# EasyEDA Pro project STM32G303的双FOC电机驱动.eprj, board axdr_v1.2
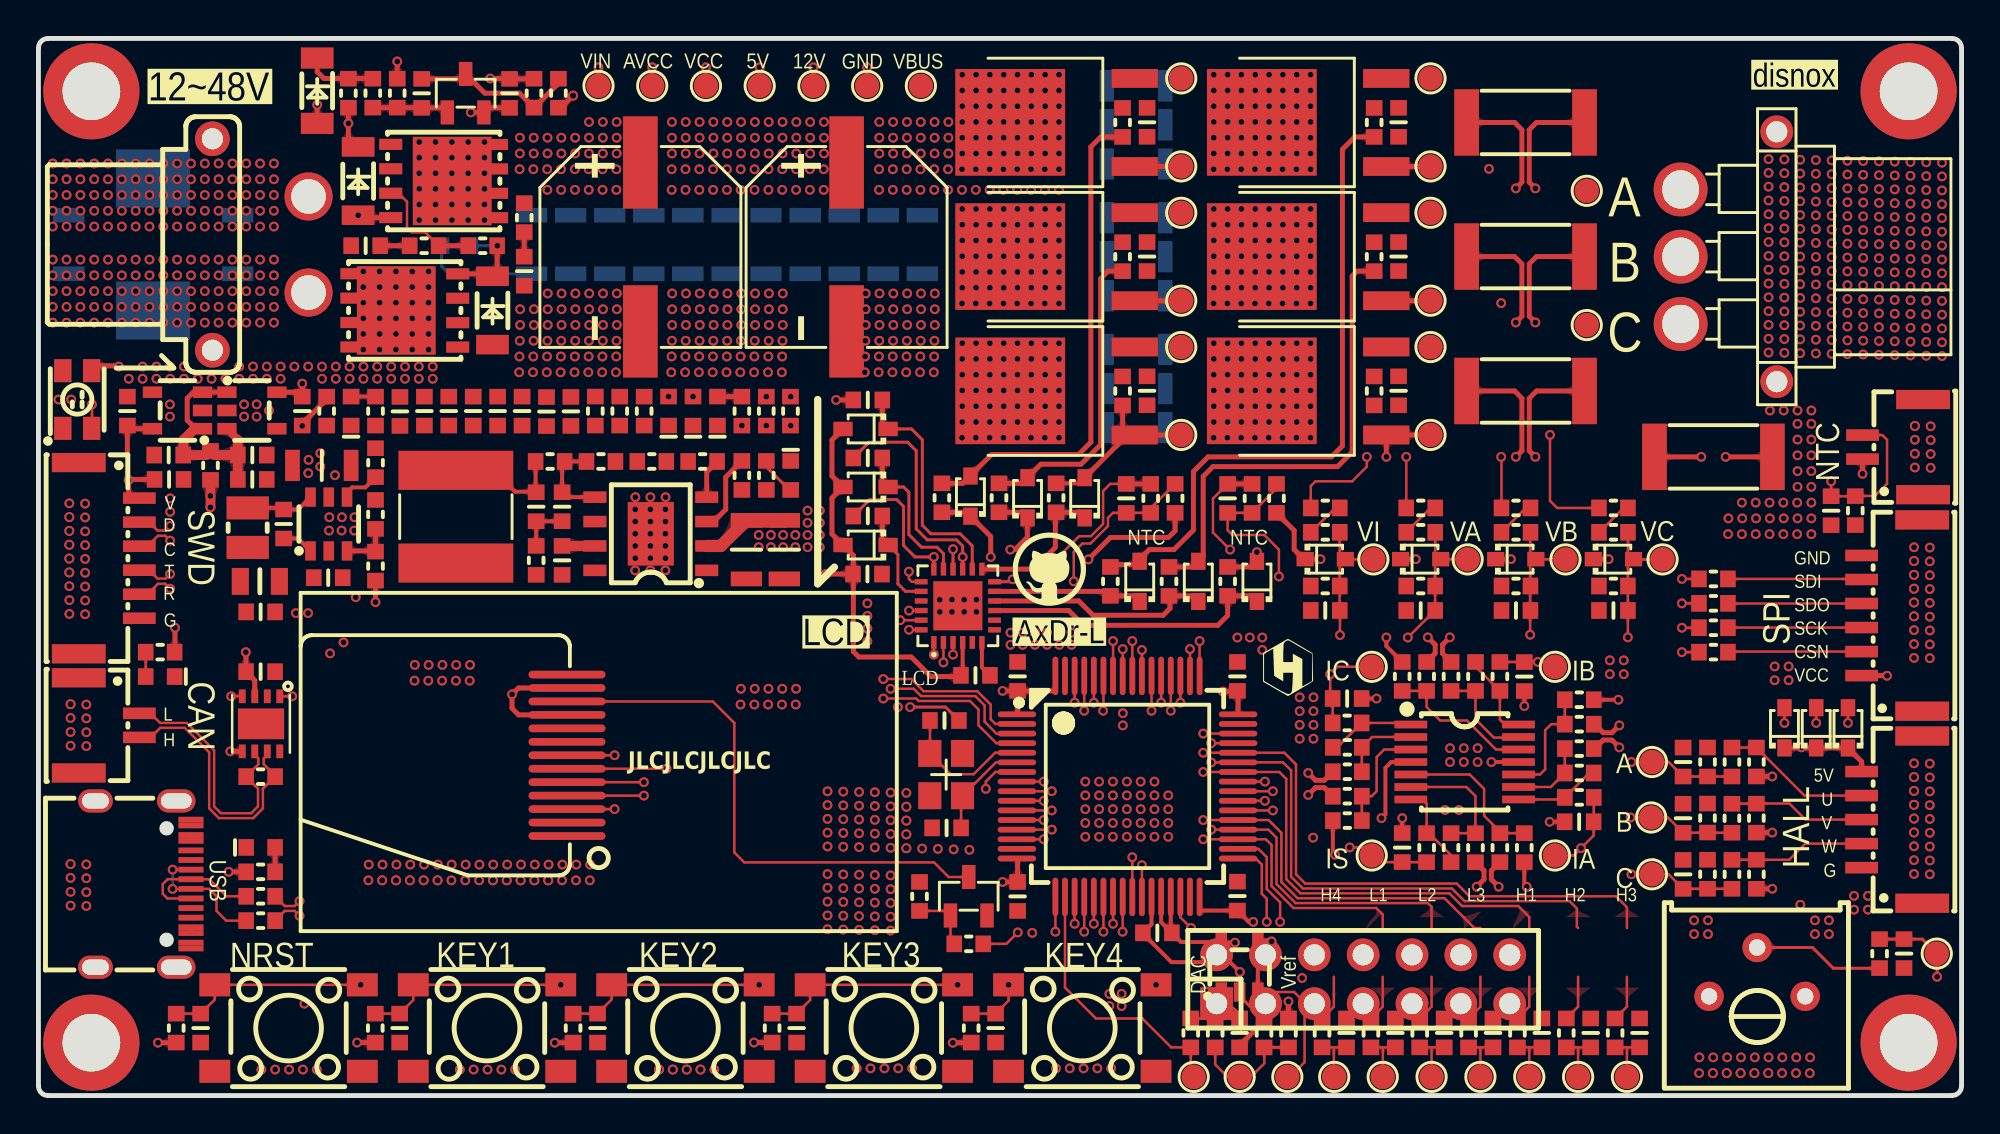
[diagram p5: board, top side]
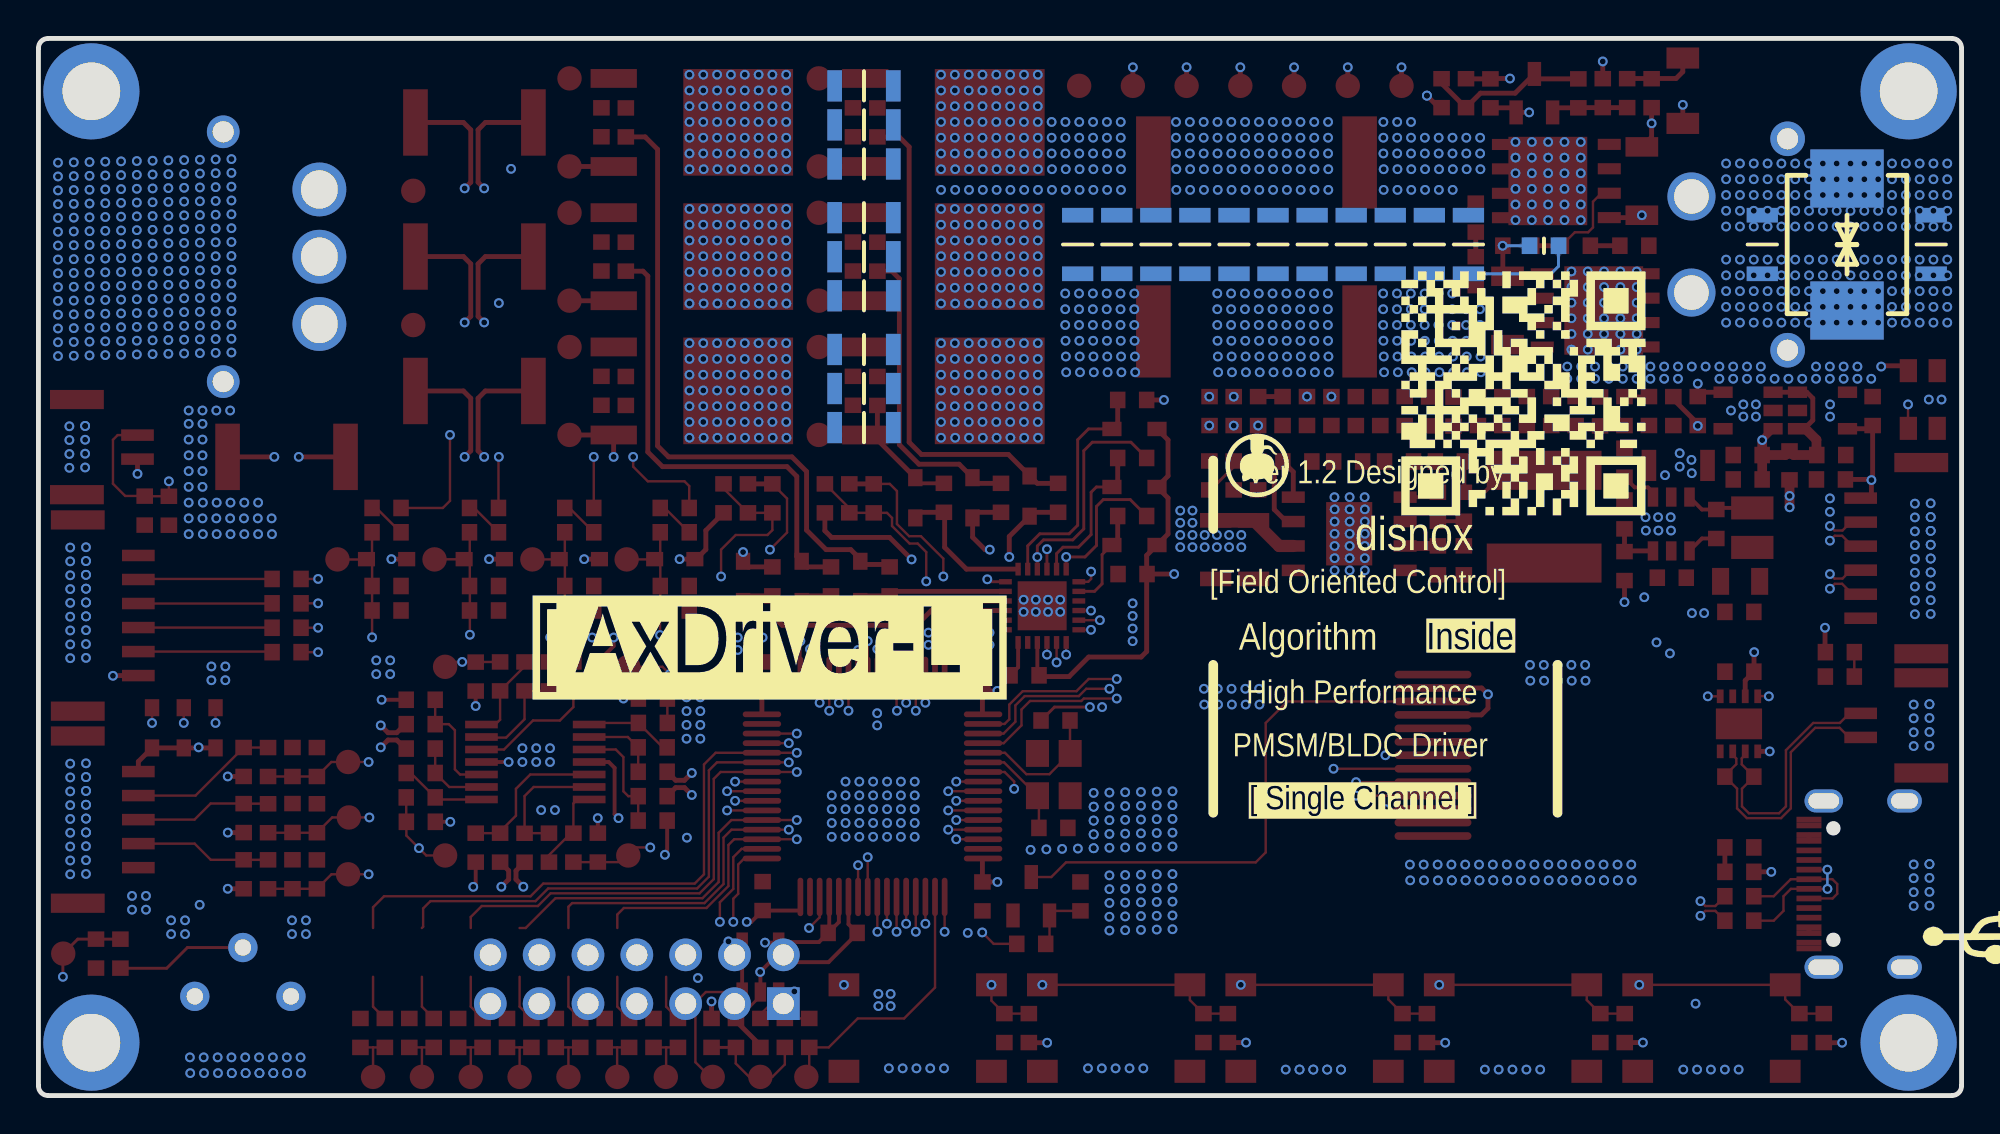
[diagram p6: board, bottom side, seen from below]

Outline 100 x 55 mm; copper layers: Top Layer, Inner1, Inner2, 内层3, 内层4, Bottom Layer. Coordinates in mm from the lower left corner of the outline.
Outline path: 0,54.5 arc(0.15,54.85) 0.5,55 99.5,55 arc(99.85,54.85) 100,54.5 100,0.5 arc(99.85,0.15) 99.5,0 0.5,0 arc(0.15,0.15) 0,0.5 0,54.5
Stack: Top Layer 0.035mm 外层铜厚1oz / Dielectric1 0.0994mm 3313 RC57% 4.2mil / Inner1 0.0152mm 内层铜厚 / Dielectric2 0.55mm 0.55mm H/H不含铜 / Inner2 0.0152mm 内层铜厚 / Dielectric3 0.1088mm 2116 RC54% 4.9mil / 内层3 0.0152mm 内层铜厚 / Dielectric4 0.55mm 0.55mm H/H不含铜 / 内层4 0.0152mm 内层铜厚 / Dielectric5 0.0994mm 3313 RC57% 4.2mil / Bottom Layer 0.035mm 外层铜厚1oz

## Design rules (mm)
template: 用户自定义配置
spacing safeClearance (default): track to track 0.127, other pairs 0.127 to 0.127
track width trackWidth (default): min 0.127, default 0.254, max 2.54
differential pair differentialPair (default): width min 0.127, default 0.254, max 2.54; gap min 0.127, default 0.127
via viaSize (default): diameter min 0.5, default 0.508, max 10; hole min 0.3, default 0.305, max 5.999

## Placement (name value [footprint] x y rotation side)
C1  100nF  [C0603_S]  24.5 52.15 90 top
C2  100nF  [C0603_S]  19.93 52.15 90 top
C3  220uF  [CAP-SMD_BD10.0-L10.3-W10.3-LS11.0-R-RD]  42.02 44.15 90 top
C4  220uF  [CAP-SMD_BD10.0-L10.3-W10.3-LS11.0-R-RD]  31.3 44.15 90 top
C5  10uF  [C1206_S]  37.83 44.41 270 bottom
C6  10uF  [C1206_S]  39.87 44.41 270 bottom
C7  10uF  [C1206_S]  45.96 44.41 270 bottom
C8  10uF  [C1206_S]  35.8 44.41 270 bottom
C9  10uF  [C1206_S]  33.77 44.41 270 bottom
C10  10uF  [C1206_S]  31.74 44.41 270 bottom
C11  10uF  [C1206_S]  43.93 44.41 270 bottom
C12  10uF  [C1206_S]  41.9 44.41 270 bottom
C13  10uF  [C1206_S]  27.67 44.41 270 bottom
C14  10uF  [C1206_S]  25.64 44.41 270 bottom
C15  10uF  [C1206_S]  29.71 44.41 270 bottom
C16  10uF  [C1206_S]  1.57 44.41 270 bottom
C17  10uF  [C1206_S]  10.36 44.41 270 bottom
C18  10nF  [C0603_S]  17.01 44.22 180 top
C19  100nF  [C0603_S]  21.7 44.22 180 bottom
C20  10nF  [C0603_S]  25.26 42.88 270 top
C21  2.2nF  [C0603_S]  27.23 27.84 270 top
C22  3.3nF  [C0603_S]  25.88 30.63 270 top
C23  10uF  [C1206_S]  38.79 28.53 270 top
C24  100nF  [C1206_S]  36.81 28.28 90 top
C25  2.2nF  [C0603_S]  27.23 30.63 270 top
C26  100nF  [C0603_S]  43.12 27.13 0 top
C27  10uF  [C0603_S]  26.42 35.58 270 top
C28  10uF  [C0603_S]  21.34 35.6 270 top
C29  10uF  [C1206_S]  14.86 32.78 180 top
C30  100nF  [C0603_S]  11.11 33.33 180 top
C31  100nF  [C0603_S]  62.34 21.8 270 top
C32  100nF  [C0603_S]  50.91 10.37 90 top
C33  100nF  [C0603_S]  6.78 32.05 180 top
C34  22pF  [C0603_S]  47.1 19.51 180 top
C35  22pF  [C0603_S]  47.23 13.93 0 top
C36  100nF  [C0603_S]  11.11 32.05 180 top
C37  10uF  [C0603_S]  18.8 35.6 90 top
C38  10uF  [C0603_S]  20.07 35.6 270 top
C39  10uF  [C0603_S]  27.69 35.6 90 top
C40  100nF  [C0603_S_3]  12.75 29.75 90 top
C41  100nF  [C0603_S]  6.78 33.33 0 top
C42  100nF  [C0603_S]  13.72 35.62 90 top
C43  100nF  [C0603_S]  58.19 8.46 0 top
C44  10uF  [C0805_S]  11.51 26.75 0 top
C45  100nF  [C0603_S]  11.56 25.16 0 top
C46  100nF  [C0603_S]  15.06 26.94 180 top
C47  100nF  [C0603_S]  11.54 22.05 180 top
C48  100nF  [C0603_S]  8.43 3.52 90 top
C49  100nF  [C0603_S]  18.78 3.52 90 top
C50  100nF  [C0603_S]  29.07 3.52 90 top
C51  100nF  [C0603_S]  39.42 3.52 90 top
C52  100nF  [C0603_S]  49.77 3.52 90 top
C53  1nF  [C0603_S]  97.01 7.39 90 top
C54  10nF  [C0603_S]  62.46 3.27 90 top
C55  100nF  [C0603_S]  50.91 21.8 270 top
C56  100nF  [C0603_S]  62.34 10.37 270 top
C57  100nF  [C0603_S]  4.62 35.6 270 top
C58  10uF  [C0603_S]  23.88 35.6 270 top
C59  10uF  [C0603_S]  25.15 35.6 270 top
C60  10uF  [C0603_S]  22.61 35.6 270 top
C61  1nF  [C0603_S]  70.91 12.89 270 top
C62  1nF  [C0603_S]  68.04 20.66 180 top
C63  1nF  [C0603_S]  57.65 50.63 270 top
C64  1nF  [C0603_S]  57.65 43.64 270 top
C65  1nF  [C0603_S]  57.65 36.66 270 top
C66  1uF  [C0603_S]  43.13 30.15 0 top
C67  1nF  [C0603_S]  80.12 14.24 0 top
C68  1nF  [C0603_S]  77.26 21.81 90 top
C69  100nF  [C0603_S]  48.71 21.86 180 top
C70  1uF  [C0603_S]  43.13 33.17 0 top
C71  1uF  [C0603_S]  43.13 36.19 0 top
C72  1nF  [C0603_S]  70.73 50.63 270 top
C73  1nF  [C0603_S]  70.73 43.64 270 top
C74  1nF  [C0603_S]  70.73 36.66 270 top
C75  1nF  [C0603_S]  71.89 25.24 0 top
C76  1nF  [C0603_S]  76.84 25.24 0 top
C77  1nF  [C0603_S]  81.91 25.24 0 top
C78  1nF  [C0603_S]  66.92 25.24 0 top
C79  1nF  [C0603_S]  61.84 31.06 270 top
C80  1nF  [C0603_S]  56.57 31.06 270 top
C81  1nF  [C0603_S]  93.22 30.44 90 top
C82  100nF  [C0603_S]  85.52 17.36 90 top
C83  100nF  [C0603_S]  85.52 14.44 90 top
C84  100nF  [C0603_S]  85.52 11.52 90 top
C85  100nF  [C0603_S]  78.18 3.27 90 top
C86  100nF  [C0603_S]  80.72 3.27 90 top
C87  100nF  [C0603_S]  83.26 3.27 90 top
C88  100nF  [C0603_S]  68.02 3.27 90 top
C91  100nF  [C0603_S]  70.56 3.27 90 top
C92  100nF  [C0603_S]  73.1 3.27 90 top
C93  100nF  [C0603_S]  75.64 3.27 90 top
C96  10uF  [C1206_S]  56.95 52.53 0 bottom
C97  10uF  [C1206_S]  56.95 45.68 0 bottom
C98  10uF  [C1206_S]  56.95 36.79 0 bottom
C99  10uF  [C1206_S]  56.95 50.5 0 bottom
C100  10uF  [C1206_S]  56.95 43.64 0 bottom
C101  10uF  [C1206_S]  56.95 48.47 0 bottom
C102  10uF  [C1206_S]  56.95 38.82 0 bottom
C103  10uF  [C1206_S]  56.95 41.61 0 bottom
C104  10uF  [C1206_S]  56.95 34.75 0 bottom
CN1  5012  [TESTPOINT-TH_BD2.0_C9900010656]  29.12 52.53 180 top
CN2  5012  [TESTPOINT-TH_BD2.0_C9900010656]  45.88 52.53 180 top
CN3  XT30PW-F  [CONN-TH_XT30PW-F]  11.54 44.28 270 top
CN4  5012  [TESTPOINT-TH_BD2.0_C9900010656]  40.3 52.53 0 top
CN5  5012  [TESTPOINT-TH_BD2.0_C9900010656]  34.71 52.53 180 top
CN6  5012  [TESTPOINT-TH_BD2.0_C9900010656]  43.09 52.53 0 top
CN7  5012  [TESTPOINT-TH_BD2.0_C9900010656]  37.5 52.53 0 top
CN8  5012  [TESTPOINT-TH_BD2.0_C9900010656]  31.91 52.53 270 top
CN9  WAFER-GH1.25-6PWB  [CONN-SMD_6P-P1.25_XUNPU_WAFER-GH1.25-6PWB]  3.67 27.96 270 top
CN10  5012  [TESTPOINT-TH_BD2.0_C9900010656]  98.71 7.38 0 top
CN11  X1251WRS-02HF-LPSW  [CONN-SMD_2P-P1.25_X1251WRS-02HF-LPSW]  3.54 19.26 270 top
CN12  5012  [TESTPOINT-TH_BD2.0_C9900010656]  60.07 0.97 0 top
CN13  5012  [TESTPOINT-TH_BD2.0_C9900010656]  64.94 0.97 0 top
CN14  5012  [TESTPOINT-TH_BD2.0_C9900010656]  69.33 12.49 0 top
CN15  5012  [TESTPOINT-TH_BD2.0_C9900010656]  69.33 22.31 0 top
CN16  5012  [TESTPOINT-TH_BD2.0_C9900010656]  62.46 0.97 0 top
CN17  5012  [TESTPOINT-TH_BD2.0_C9900010656]  59.42 48.34 0 top
CN18  5012  [TESTPOINT-TH_BD2.0_C9900010656]  59.42 41.36 0 top
CN19  5012  [TESTPOINT-TH_BD2.0_C9900010656]  59.42 34.37 0 top
CN20  5012  [TESTPOINT-TH_BD2.0_C9900010656]  78.85 12.49 180 top
CN21  5012  [TESTPOINT-TH_BD2.0_C9900010656]  78.85 22.31 0 top
CN22  5012  [TESTPOINT-TH_BD2.0_C9900010656]  59.42 52.92 0 top
CN23  5012  [TESTPOINT-TH_BD2.0_C9900010656]  59.42 45.93 0 top
CN24  5012  [TESTPOINT-TH_BD2.0_C9900010656]  59.42 38.94 0 top
CN25  5012  [TESTPOINT-TH_BD2.0_C9900010656]  72.39 48.34 0 top
CN26  5012  [TESTPOINT-TH_BD2.0_C9900010656]  72.39 41.36 0 top
CN27  5012  [TESTPOINT-TH_BD2.0_C9900010656]  72.39 34.37 0 top
CN28  5012  [TESTPOINT-TH_BD2.0_C9900010656]  72.39 52.92 0 top
CN29  5012  [TESTPOINT-TH_BD2.0_C9900010656]  72.39 45.93 0 top
CN30  5012  [TESTPOINT-TH_BD2.0_C9900010656]  72.39 38.94 0 top
CN31  5012  [TESTPOINT-TH_BD2.0_C9900010656]  83.9 17.35 270 top
CN32  5012  [TESTPOINT-TH_BD2.0_C9900010656]  83.86 14.47 270 top
CN33  5012  [TESTPOINT-TH_BD2.0_C9900010656]  83.9 11.51 270 top
CN34  X1251WRS-02HF-LPSW  [CONN-SMD_2P-P1.25_X1251WRS-02HF-LPSW]  96.55 33.74 90 top
CN35  5012  [TESTPOINT-TH_BD2.0_C9900010656]  80.51 40.09 0 top
CN36  5012  [TESTPOINT-TH_BD2.0_C9900010656]  80.51 47.07 0 top
CN37  5012  [TESTPOINT-TH_BD2.0_C9900010656]  74.32 27.9 90 top
CN38  5012  [TESTPOINT-TH_BD2.0_C9900010656]  79.4 27.9 90 top
CN39  5012  [TESTPOINT-TH_BD2.0_C9900010656]  84.45 27.9 90 top
CN40  5012  [TESTPOINT-TH_BD2.0_C9900010656]  69.41 27.9 90 top
CN41  MR30PW-F  [CONN-TH_MR30PW-F]  87.89 43.64 90 top
CN42  5012  [TESTPOINT-TH_BD2.0_C9900010656]  77.52 0.97 90 top
CN43  5012  [TESTPOINT-TH_BD2.0_C9900010656]  80.06 0.97 0 top
CN44  5012  [TESTPOINT-TH_BD2.0_C9900010656]  82.6 0.97 0 top
CN45  5012  [TESTPOINT-TH_BD2.0_C9900010656]  67.38 0.97 0 top
CN47  WAFER-GH1.25-6PWB  [CONN-SMD_6P-P1.25_XUNPU_WAFER-GH1.25-6PWB]  96.38 24.97 90 top
CN49  5012  [TESTPOINT-TH_BD2.0_C9900010656]  69.9 0.97 0 top
CN50  5012  [TESTPOINT-TH_BD2.0_C9900010656]  72.44 0.97 180 top
CN51  5012  [TESTPOINT-TH_BD2.0_C9900010656]  74.98 0.97 0 top
D1  ZMM12V  [LL-34_L3.5-W1.5-RD-2]  16.62 47.58 270 top
D2  1.5SMC30CAHE3/57T  [SMC_L6.8-W5.9-LS7.8-BI]  5.96 44.28 270 bottom
D3  ZMM12V  [LL-34_L3.5-W1.5-RD-2]  23.61 40.85 270 top
D4  TCLLZ39VTR  [LL-34_L3.5-W1.5-RD]  14.49 52.28 270 top
D5  B16WS  [SOD-323_L1.8-W1.3-LS2.5-RD#2]  48.46 31.19 90 top
D6  B16WS  [SOD-323_L1.8-W1.3-LS2.5-RD#2]  51.43 31.1 90 top
D7  B16WS  [SOD-323_L1.8-W1.3-LS2.5-RD#2]  54.4 31.1 90 top
D8  B16WS  [SOD-323_L1.8-W1.3-LS2.5-RD]  43.01 28.64 180 top
D9  B16WS  [SOD-323_L1.8-W1.3-LS2.5-RD]  43.01 31.66 180 top
D10  B16WS  [SOD-323_L1.8-W1.3-LS2.5-RD]  43.01 34.68 180 top
D11  B16WS  [SOD-323_L1.8-W1.3-LS2.5-RD#2]  57.26 26.75 90 top
D12  B16WS  [SOD-323_L1.8-W1.3-LS2.5-RD#2]  60.31 26.75 90 top
D13  B16WS  [SOD-323_L1.8-W1.3-LS2.5-RD#2]  63.36 26.75 90 top
D14  B16WS  [SOD-323_L1.8-W1.3-LS2.5-RD#2]  94.09 19.13 90 top
D15  B16WS  [SOD-323_L1.8-W1.3-LS2.5-RD#2]  71.87 27.91 0 top
D16  B16WS  [SOD-323_L1.8-W1.3-LS2.5-RD#2]  76.82 27.91 0 top
D17  B16WS  [SOD-323_L1.8-W1.3-LS2.5-RD#2]  81.9 27.91 0 top
D18  B16WS  [SOD-323_L1.8-W1.3-LS2.5-RD#2]  66.91 27.91 0 top
D19  B16WS  [SOD-323_L1.8-W1.3-LS2.5-RD#2]  90.79 19.13 90 top
D20  B16WS  [SOD-323_L1.8-W1.3-LS2.5-RD#2]  92.44 19.13 90 top
H1  2.54-2*7P针  [HDR-TH_14P-P2.54-V-F-R2-C6-S2.54]  67.36 6.18 0 top
IPSLCD1  TFT_1.14_135x240_13pin  [焊接式_TFT_1.14_135X240_13PIN]  13.63 17.35 180 top
K1  TS-KG02S  [SW-SMD_4P-L6.0-W6.0-P4.50-LS8.5]  13 3.51 0 top
K2  TS-KG02S  [SW-SMD_4P-L6.0-W6.0-P4.50-LS8.5]  23.32 3.51 0 top
K3  TS-KG02S  [SW-SMD_4P-L6.0-W6.0-P4.50-LS8.5]  33.64 3.51 0 top
K4  TS-KG02S  [SW-SMD_4P-L6.0-W6.0-P4.50-LS8.5]  43.96 3.51 0 top
K5  TS-KG02S  [SW-SMD_4P-L6.0-W6.0-P4.50-LS8.5]  54.28 3.51 0 top
L1  NCD0603R1  [LED0603_S]  39.12 32.89 90 top
L2  68uH  [IND-SMD_L6.0-W6.0_SMNR6045]  21.7 30.12 270 top
L3  NCD0603R1  [LED0603_S]  6.96 21.8 0 top
L4  NCD0603R1  [LED0603_S]  16.26 34.99 270 top
L5  NCD0603R1  [LED0603_S]  10.93 12.91 180 top
L6  NCD0603G1  [LED0603_S]  32.77 34.99 270 top
L7  4.7uH  [IND-SMD_L2.5-W2.0]  10.88 29.55 90 top
L8  NCD0603W1  [LED0603_S]  34.04 34.99 270 top
L9  NCD0603B1  [LED0603_S]  35.31 34.99 270 top
LED1  XL-3528RGBW-WS2812B  [LED-SMD_4P-L3.5-W2.8-BR-1]  2.02 36.21 270 top
NOREF  -  [Pad_e122]  97.25 2.75 0 top
NOREF#2  -  [Pad_e118]  2.75 2.75 0 top
NOREF#3  -  [Pad_e124]  97.25 52.25 0 top
NOREF#4  -  [Pad_e113]  2.75 52.25 0 top
NTC1  NCP18XH103F03RB  [R0603_S]  63.11 31.07 90 top
NTC2  NCP18XH103F03RB  [R0603_S]  57.84 31.07 90 top
Q1  WSD90P06DN56  [DFN-8_L5.8-W4.9-P1.27-LS6.0-BL-1]  21.07 47.58 270 top
Q2  FMMT593  [SOT-23-3_L2.9-W1.3-P1.90-LS2.4-BR]  22.21 52.15 270 top
Q3  WSD80120DN56  [DFN-8_L5.8-W4.9-P1.27-LS6.0-BL-1]  19.05 40.85 90 top
Q4  SS8050  [SOT-23-3_L2.9-W1.3-P1.90-LS2.4-BR]  48.37 10.37 270 top
Q5  NCE7560K  [TO-252-2_L6.6-W6.1-P4.58-LS9.9-BR]  53.96 50.63 0 top
Q6  NCE7560K  [TO-252-2_L6.6-W6.1-P4.58-LS9.9-BR]  53.96 43.64 0 top
Q7  NCE7560K  [TO-252-2_L6.6-W6.1-P4.58-LS9.9-BR]  53.96 36.66 0 top
Q8  NCE7560K  [TO-252-2_L6.6-W6.1-P4.58-LS9.9-BR]  67.04 50.63 0 top
Q9  NCE7560K  [TO-252-2_L6.6-W6.1-P4.58-LS9.9-BR]  67.04 43.64 0 top
Q10  NCE7560K  [TO-252-2_L6.6-W6.1-P4.58-LS9.9-BR]  67.04 36.66 0 top
R1  10kΩ  [R0603_S]  37.85 32.26 270 top
R2  1.5MΩ  [R0603_S]  18.66 52.15 90 top
R3  100kΩ  [R0603_S]  16.12 52.15 270 top
R4  22Ω  [R0603_S]  20.05 44.22 0 top
R5  100kΩ  [R0603_S]  23.1 44.22 180 top
R6  1kΩ  [R0603_S]  17.39 52.15 90 top
R7  22Ω  [R0603_S]  25.26 45.68 90 top
R8  1kΩ  [R0603_S]  25.77 52.15 270 top
R9  1kΩ  [R0603_S]  27.04 52.15 270 top
R10  0Ω  [R0603_S]  31.5 35.61 270 top
R11  0Ω  [R0603_S]  30.23 35.61 270 top
R12  0Ω  [R0603_S]  14.99 35.61 270 top
R13  453kΩ  [R0603_S]  25.88 27.84 90 top
R14  1kΩ  [R0603_S]  6.33 23.07 180 top
R15  100kΩ  [R0603_S]  36.58 32.26 90 top
R16  453kΩ  [R0603_S]  26.6 32.99 0 top
R17  22Ω  [R0603_S]  11.55 9.1 0 top
R18  22Ω  [R0603_S]  11.55 10.37 0 top
R19  100kΩ  [R0603_S]  34.54 32.99 180 top
R20  49.9kΩ  [R0603_S]  29.25 32.99 0 top
R21  1kΩ  [R0603_S]  48.37 7.89 0 top
R22  1kΩ  [R0603_S]  45.82 10.36 90 top
R23  0Ω  [R0603_S]  31.89 32.99 0 top
R24  0Ω  [R0603_S]  28.96 35.61 90 top
R25  10kΩ  [R0603_S]  17.53 35.61 270 top
R26  1kΩ  [R0603_S]  11.55 11.64 180 top
R27  0Ω  [R0603_S]  8.95 32.78 90 top
R28  1kΩ  [R0603_S]  39.1 35.61 270 top
R29  10kΩ  [R0603_S]  7.16 3.51 270 top
R30  10kΩ  [R0603_S]  17.51 3.51 270 top
R31  10kΩ  [R0603_S]  27.8 3.51 270 top
R32  10kΩ  [R0603_S]  38.15 3.51 270 top
R33  10kΩ  [R0603_S]  48.5 3.51 270 top
R34  1kΩ  [R0603_S]  37.85 35.61 90 top
R35  10kΩ  [RES-ADJ-TH_3P-L9.5-W9.5-P2.50-L_3386P]  89.37 6.43 180 top
R36  62kΩ  [R0603_S]  17.53 27.55 90 top
R37  10kΩ  [R0603_S]  95.74 7.38 270 top
R38  10kΩ  [R0603_S]  17.53 32.92 90 top
R39  12kΩ  [R0603_S]  17.53 30.23 90 top
R40  1kΩ  [R0603_S]  36.58 35.61 270 top
R41  20kΩ  [R0603_S]  73.45 12.9 90 top
R42  20kΩ  [R0603_S]  68.06 18.12 0 top
R44  1kΩ  [R0603_S]  74.72 12.89 90 top
R45  1kΩ  [R0603_S]  68.06 16.85 0 top
R46  10kΩ  [R0603_S]  65 3.26 90 top
R47  0Ω  [R0603_S]  59.92 3.26 90 top
R49  1kΩ  [R0603_S]  75.99 12.9 90 top
R50  22Ω  [R0603_S]  72.18 12.9 90 top
R51  20kΩ  [R0603_S]  77.26 12.9 90 top
R52  1kΩ  [R0603_S]  68.06 15.58 0 top
R53  22Ω  [R0603_S]  68.05 19.39 0 top
R54  0Ω  [R0603_S]  61.19 3.26 90 top
R55  20kΩ  [R0603_S]  68.06 14.31 0 top
R57  10kΩ  [R0603_S]  63.73 3.26 270 top
R59  22Ω  [R0603_S]  46.98 31.1 270 top
R60  22Ω  [R0603_S]  49.95 31.1 270 top
R61  22Ω  [R0603_S]  52.92 31.1 270 top
R62  10kΩ  [R0603_S]  56.38 50.63 90 top
R63  10kΩ  [R0603_S]  56.38 43.64 90 top
R64  10kΩ  [R0603_S]  56.38 36.66 90 top
R65  20kΩ  [R0603_S]  80.12 16.78 180 top
R66  20kΩ  [R0603_S]  74.72 21.81 270 top
R67  1kΩ  [R0603_S]  80.12 18.05 180 top
R68  1kΩ  [R0603_S]  73.45 21.81 270 top
R69  1kΩ  [R0603_S]  80.12 19.32 180 top
R70  22Ω  [R0603_S]  80.12 15.51 180 top
R71  20kΩ  [R0603_S]  80.12 20.59 180 top
R72  1kΩ  [R0603_S]  72.19 21.81 270 top
R73  22Ω  [R0603_S]  76 21.81 270 top
R74  20kΩ  [R0603_S]  70.91 21.81 270 top
R75  22Ω  [R0603_S]  55.74 26.75 270 top
R76  22Ω  [R0603_S]  58.79 26.75 270 top
R77  22Ω  [R0603_S]  61.84 26.75 270 top
R78  10kΩ  [R0603_S]  69.46 50.63 90 top
R79  10kΩ  [R0603_S]  69.46 43.64 90 top
R80  10kΩ  [R0603_S]  69.46 36.66 90 top
R81  5mΩ  [R2512_S]  77.33 50.63 0 top
R82  5mΩ  [R2512_S]  77.33 43.65 0 top
R83  5mΩ  [R2512_S]  77.33 36.66 0 top
R84  15kΩ  [R0603_S]  71.88 30.57 0 top
R85  15kΩ  [R0603_S]  76.83 30.57 0 top
R86  15kΩ  [R0603_S]  81.9 30.57 0 top
R87  15kΩ  [R0603_S]  66.91 30.57 0 top
R88  10kΩ  [R0603_S]  89.33 17.35 90 top
R89  10kΩ  [R0603_S]  89.33 14.43 90 top
R90  10kΩ  [R0603_S]  89.33 11.51 90 top
R91  15kΩ  [R0603_S]  71.88 29.31 0 top
R92  15kΩ  [R0603_S]  76.83 29.31 0 top
R93  15kΩ  [R0603_S]  81.9 29.31 0 top
R94  15kΩ  [R0603_S]  66.91 29.31 0 top
R95  10kΩ  [R0603_S]  88.06 17.35 270 top
R96  120Ω  [R0603_S]  11.55 16.59 180 top
R97  10kΩ  [R0603_S]  88.06 14.43 270 top
R98  10kΩ  [R0603_S]  88.06 11.51 270 top
R99  2kΩ  [R0603_S]  71.88 26.51 180 top
R100  2kΩ  [R0603_S]  76.83 26.51 180 top
R101  2kΩ  [R0603_S]  81.9 26.51 180 top
R102  2kΩ  [R0603_S]  66.91 26.51 180 top
R103  10kΩ  [R0603_S]  64.38 31.07 90 top
R104  10kΩ  [R0603_S]  59.11 31.07 90 top
R105  10kΩ  [R0603_S]  94.48 30.44 270 top
R106  10kΩ  [R0603_S]  86.79 17.35 90 top
R107  10kΩ  [R0603_S]  86.79 14.44 90 top
R108  10kΩ  [R0603_S]  86.79 11.51 90 top
R109  5mΩ  [R2512_S]  87.1 33.23 0 top
R111  10kΩ  [R0603_S]  76.91 3.26 90 top
R112  10kΩ  [R0603_S]  79.45 3.26 90 top
R113  10kΩ  [R0603_S]  81.99 3.26 90 top
R114  10kΩ  [R0603_S]  66.75 3.26 90 top
R117  22Ω  [R0603_S]  87.1 26.88 180 top
R118  22Ω  [R0603_S]  87.1 25.61 180 top
R120  22Ω  [R0603_S]  87.1 24.34 180 top
R121  22Ω  [R0603_S]  87.1 23.07 180 top
R122  10kΩ  [R0603_S]  69.29 3.26 90 top
R123  10kΩ  [R0603_S]  71.83 3.26 90 top
R124  10kΩ  [R0603_S]  74.37 3.26 90 top
U1  STM32G431RBT6  [LQFP-64_L10.0-W10.0-P0.50-LS12.0-BL]  56.63 16.08 270 top
U2  LM5164DDAR  [ESOP-8_L4.9-W3.9-P1.27-LS6.0-BL-EP]  31.84 29.23 90 top
U3  XC6210B332MR  [SOT-23-5_L3.0-W1.7-P0.95-LS2.8-BR]  7.23 35.64 0 top
U4  LP5907QMFX-3.3Q1  [SOT-23-5_L3.0-W1.7-P0.95-LS2.8-BR]  11.1 35.64 180 top
U5  RY8411  [SOT-23-6_L2.9-W1.6-P0.95-LS2.8-BR]  15.1 29.74 270 top
U6  LM321MF/NOPB  [SOT-23-5_L3.0-W1.7-P0.95-LS2.8-BR]  62.46 6.69 270 top
U7  FD6288Q  [QFN-24_L4.0-W4.0-P0.50-BL-EP2.6]  47.81 25.48 0 top
U8  WAFER-GH1.25-5PWB  [conn-smd_5p-p1.25_xunpu_wafer-gh1.25-5pwb]  96.38 14.36 90 top
U9  TJA1051TK/3/1J  [HVSON-8_L3.0-W3.0-P0.65-BL-EP]  11.57 19.34 180 top
U10  RS624XQ  [TSSOP-14_L5.0-W4.4-P0.65-LS6.4-BL]  74.16 17.35 270 top
USBC1  -  [USB-C_SMD-TYPE-C-31-M-12]  5.45 11 270 top
X1  8MHz  [CRYSTAL-SMD_4P-L3.2-W2.5-BL]  47.2 16.7 270 top

## Footprints (pads in the part's own frame, mm; a bottom-side part is the same pattern mirrored in y, then rotated)
C0603_S
  rect 0.806x0.864 smd: 1(-0.762,0) 2(0.745,0)
C0603_S_3
  rect 0.806x0.864 smd: 1(-0.762,0) 2(0.745,0)
C0805_S
  rect 0.889x1.399 smd: 1(1.016,0) 2(-1.016,0)
C1206_S
  rect 0.762x1.625 smd: 1(1.651,0) 2(-1.397,0)
CAP-SMD_BD10.0-L10.3-W10.3-LS11.0-R-RD
  rect 4.8x1.8 smd: 1(4.395,0) 2(-4.395,0)
CONN-SMD_2P-P1.25_X1251WRS-02HF-LPSW
  rect 0.6x1.7 smd: 1(-0.625,1.702) 2(0.625,1.702)
  rect 1x2.799 smd: 3(2.475,-1.448) 4(-2.475,-1.448)
conn-smd_5p-p1.25_xunpu_wafer-gh1.25-5pwb
  rect 0.6x1.7 smd: 1(-2.5,1.575) 2(-1.25,1.575) 3(-0.001,1.575) 4(1.25,1.575) 5(2.5,1.575)
  rect 1x2.8 smd: 6(4.35,-1.575) 7(-4.35,-1.575)
CONN-SMD_6P-P1.25_XUNPU_WAFER-GH1.25-6PWB
  rect 0.6x1.7 smd: 1(-3.125,1.575) 2(-1.875,1.575) 3(-0.625,1.575) 4(0.625,1.575) 5(1.875,1.575) 6(3.125,1.575)
  rect 1x2.8 smd: 7(4.975,-1.575) 8(-4.975,-1.575)
CONN-TH_MR30PW-F
  round 2.8 hole 1.995x1.9: 1(-3.5,2.5) 2(0,2.5) 3(3.5,2.5)
  round 1.7 hole 1.1: 4(6.5,-2.5) 5(-6.5,-2.5)
CONN-TH_XT30PW-F
  round 2.5 hole 1.8: 1(-2.5,2.5) 2(2.5,2.5)
  round 1.8 hole 1.1: 3(5.5,-2.5) 4(-5.5,-2.5)
CRYSTAL-SMD_4P-L3.2-W2.5-BL
  rect 1.4x1.2 smd: 1(-1.1,-0.85) 2(1.1,-0.85) 3(1.1,0.85) 4(-1.1,0.85)
DFN-8_L5.8-W4.9-P1.27-LS6.0-BL-1
  rect 0.579x1.199 smd: 1(1.903,-2.751) 2(-1.903,2.751) 2(-0.632,2.751) 2(0.637,2.751) 2(1.907,2.751) 3(-1.907,-2.751) 3(-0.637,-2.751) 3(0.632,-2.751)
  rect 4.6x4.099 smd: 2(-0.003,0.445)
ESOP-8_L4.9-W3.9-P1.27-LS6.0-BL-EP
  rect 0.6x1.2 smd: 1(-1.905,-2.909) 2(-0.635,-2.909) 3(0.635,-2.909) 4(1.905,-2.909) 5(1.905,2.909) 6(0.635,2.909) 7(-0.635,2.909) 8(-1.905,2.909)
  rect 3.3x2.4 smd: 9(0,0)
HDR-TH_14P-P2.54-V-F-R2-C6-S2.54
  rect 1.7x1.7 hole 1.1: 1(-6.096,-1.397)
  round 1.7 hole 1.1: 2(-6.096,1.143) 3(-3.556,-1.397) 4(-3.556,1.143) 5(-1.016,-1.397) 6(-1.016,1.143) 7(1.524,-1.397) 8(1.524,1.143) 9(4.064,-1.397) 10(4.064,1.143) 11(6.604,-1.397) 12(6.604,1.143) 13(9.144,-1.397) 14(9.144,1.143)
HVSON-8_L3.0-W3.0-P0.65-BL-EP
  rect 0.355x0.711 smd: 1(-0.976,-1.433) 2(-0.325,-1.433) 3(0.325,-1.433) 4(0.976,-1.433) 5(0.976,1.433) 6(0.325,1.433) 7(-0.325,1.433) 8(-0.976,1.433)
  rect 2.401x1.6 smd: 9(0,0)
IND-SMD_L2.5-W2.0
  rect 1.2x2.2 smd: 1(1.028,0) 2(-1.028,0)
IND-SMD_L6.0-W6.0_SMNR6045
  rect 2.032x5.969 smd: 1(2.413,0) 2(-2.413,0)
LED0603_S
  rect 0.806x0.864 smd: 1(-1.381,-0.001) 2(0.126,-0.001)
LED-SMD_4P-L3.5-W2.8-BR-1
  rect 1.2x0.9 smd: 1(1.5,-0.75) 2(1.5,0.75) 3(-1.5,0.75) 4(-1.5,-0.75)
LL-34_L3.5-W1.5-RD
  rect 1.1x1.7 smd: 1(-1.7,0) 2(1.7,0)
LL-34_L3.5-W1.5-RD-2
  rect 1.016x1.7 smd: 1(-1.778,0) 2(1.778,0)
LQFP-64_L10.0-W10.0-P0.50-LS12.0-BL
  oval 0.3x2 smd: 1(-3.75,-5.75) 2(-3.25,-5.75) 3(-2.75,-5.75) 4(-2.25,-5.75) 5(-1.75,-5.75) 6(-1.25,-5.75) 7(-0.75,-5.75) 8(-0.25,-5.75) 9(0.25,-5.75) 10(0.75,-5.75) 11(1.25,-5.75) 12(1.75,-5.75) 13(2.25,-5.75) 14(2.75,-5.75) 15(3.25,-5.75) 16(3.75,-5.75) 33(3.75,5.75) 34(3.25,5.75) 35(2.75,5.75) 36(2.25,5.75) 37(1.75,5.75) 38(1.25,5.75) 39(0.75,5.75) 40(0.25,5.75) 41(-0.25,5.75) 42(-0.75,5.75) 43(-1.25,5.75) 44(-1.75,5.75) 45(-2.25,5.75) 46(-2.75,5.75) 47(-3.25,5.75) 48(-3.75,5.75)
  oval 2x0.3 smd: 17(5.75,-3.75) 18(5.75,-3.25) 19(5.75,-2.75) 20(5.75,-2.25) 21(5.75,-1.75) 22(5.75,-1.25) 23(5.75,-0.75) 24(5.75,-0.25) 25(5.75,0.25) 26(5.75,0.75) 27(5.75,1.25) 28(5.75,1.75) 29(5.75,2.25) 30(5.75,2.75) 31(5.75,3.25) 32(5.75,3.75) 49(-5.75,3.75) 50(-5.75,3.25) 51(-5.75,2.75) 52(-5.75,2.25) 53(-5.75,1.75) 54(-5.75,1.25) 55(-5.75,0.75) 56(-5.75,0.25) 57(-5.75,-0.25) 58(-5.75,-0.75) 59(-5.75,-1.25) 60(-5.75,-1.75) 61(-5.75,-2.25) 62(-5.75,-2.75) 63(-5.75,-3.25) 64(-5.75,-3.75)
Pad_e113
  round 5 hole 3: 1(0,0)
Pad_e118
  round 5 hole 3: 1(0,0)
Pad_e122
  round 5 hole 3: 1(0,0)
Pad_e124
  round 5 hole 3: 1(0,0)
QFN-24_L4.0-W4.0-P0.50-BL-EP2.6
  rect 0.28x0.665 smd: 1(-1.25,-1.907) 2(-0.75,-1.907) 3(-0.25,-1.907) 4(0.25,-1.907) 5(0.75,-1.907) 6(1.25,-1.907) 13(1.25,1.907) 14(0.75,1.907) 15(0.25,1.907) 16(-0.25,1.907) 17(-0.75,1.907) 18(-1.25,1.907)
  rect 0.665x0.28 smd: 7(1.907,-1.25) 8(1.907,-0.75) 9(1.907,-0.25) 10(1.907,0.25) 11(1.907,0.75) 12(1.907,1.25) 19(-1.907,1.25) 20(-1.907,0.75) 21(-1.907,0.25) 22(-1.907,-0.25) 23(-1.907,-0.75) 24(-1.907,-1.25)
  rect 2.55x2.55 smd: 25(0,0)
R0603_S
  rect 0.806x0.864 smd: 1(-0.752,0) 2(0.754,0)
R2512_S
  rect 1.282x3.456 smd: 1(-3.067,0) 2(3.067,0)
RES-ADJ-TH_3P-L9.5-W9.5-P2.50-L_3386P
  round 1.524 hole 0.85: 1(-2.5,1.27) 2(0,-1.27) 3(2.5,1.27)
SMC_L6.8-W5.9-LS7.8-BI
  rect 3.03x3.82 smd: 1(3.434,0) 2(-3.434,0)
SOD-323_L1.8-W1.3-LS2.5-RD
  rect 1x0.75 smd: 1(-1.173,0) 2(1.173,0)
SOD-323_L1.8-W1.3-LS2.5-RD#2
  rect 0.889x0.75 smd: 1(-1.046,0) 2(1.046,0)
SOT-23-3_L2.9-W1.3-P1.90-LS2.4-BR
  rect 1.25x0.7 smd: 1(1,-0.95) 2(1,0.95) 3(-1,0)
SOT-23-5_L3.0-W1.7-P0.95-LS2.8-BR
  rect 1x0.6 smd: 1(1.3,-0.95) 2(1.3,0) 3(1.3,0.95) 4(-1.3,0.95) 5(-1.3,-0.95)
SOT-23-6_L2.9-W1.6-P0.95-LS2.8-BR
  rect 1x0.55 smd: 1(1.4,-0.95) 2(1.4,0) 3(1.4,0.95) 4(-1.4,0.95) 5(-1.4,0) 6(-1.4,-0.95)
SW-SMD_4P-L6.0-W6.0-P4.50-LS8.5
  rect 1.6x1.2 smd: 1(-3.835,-2.25) 1(3.835,-2.25) 2(-3.835,2.25) 2(3.835,2.25)
TESTPOINT-TH_BD2.0_C9900010656
  round 1.27 smd: 1(0,0)
TO-252-2_L6.6-W6.1-P4.58-LS9.9-BR
  rect 2.408x0.978 smd: 1(3.043,-2.291) 3(3.043,2.291)
  rect 5.71x5.548 smd: 2(-3.429,0.006)